# EasyEDA Pro project MyWordEdit.eprj, schematic Schematic1

## Sheets
1 凯华配列: Create Date: 2023-07-25; Page Name: 凯华配列; Project Name: MyWordEdit; Schematic Name: Schematic1; Update Date: 2023-07-29; Company: 嘉立创EDA; Page Size: A4; Version: V1.0
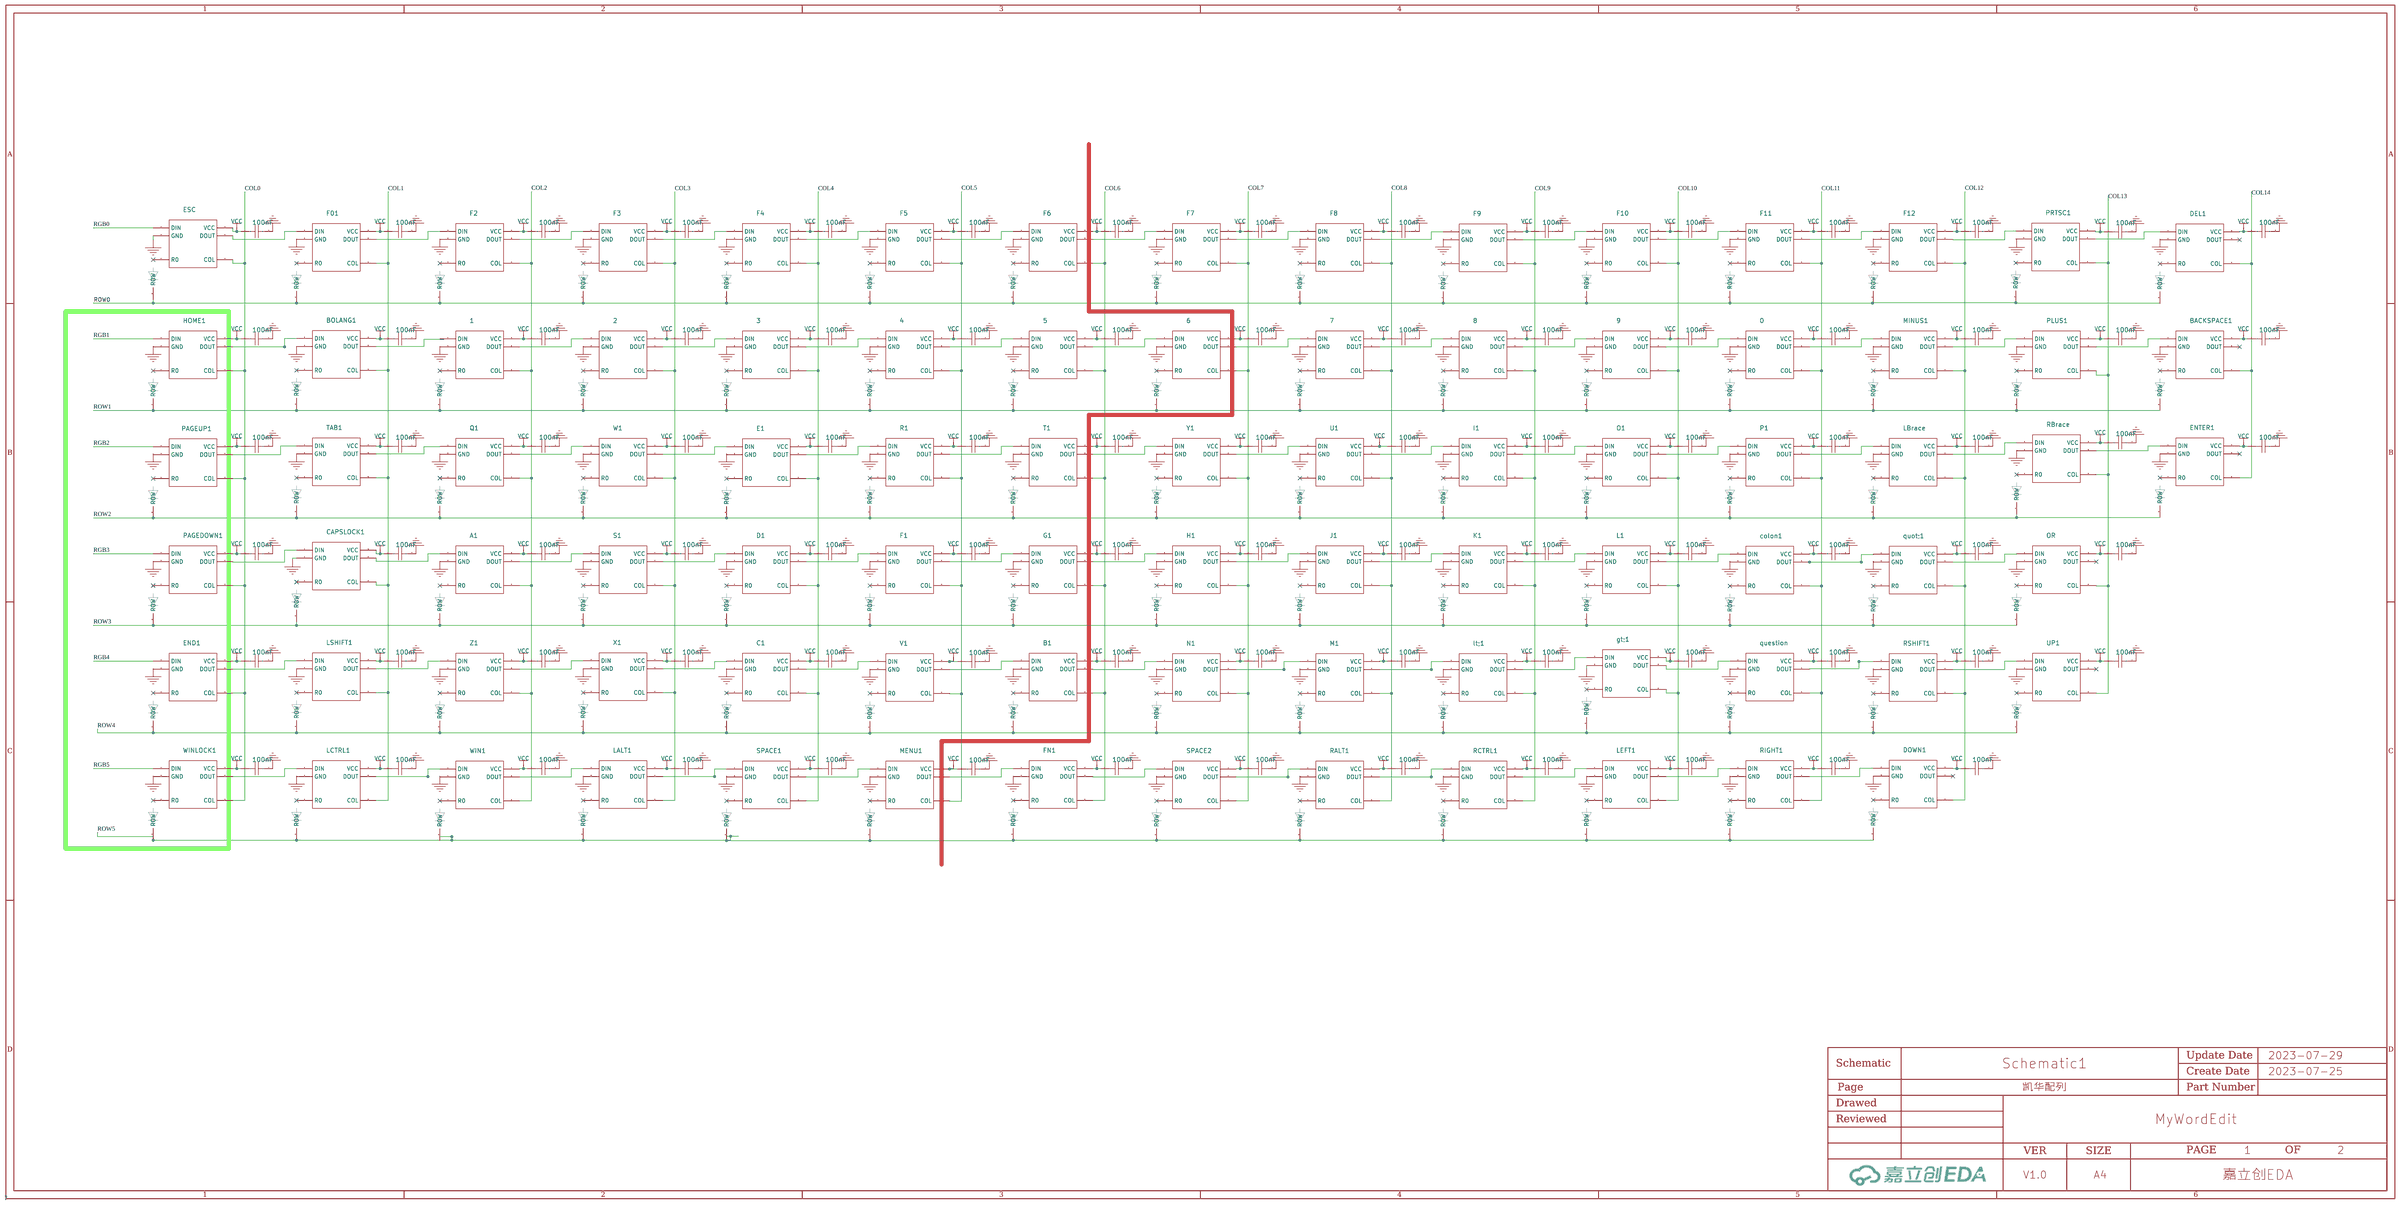
[diagram p0: 凯华配列]
2 主控
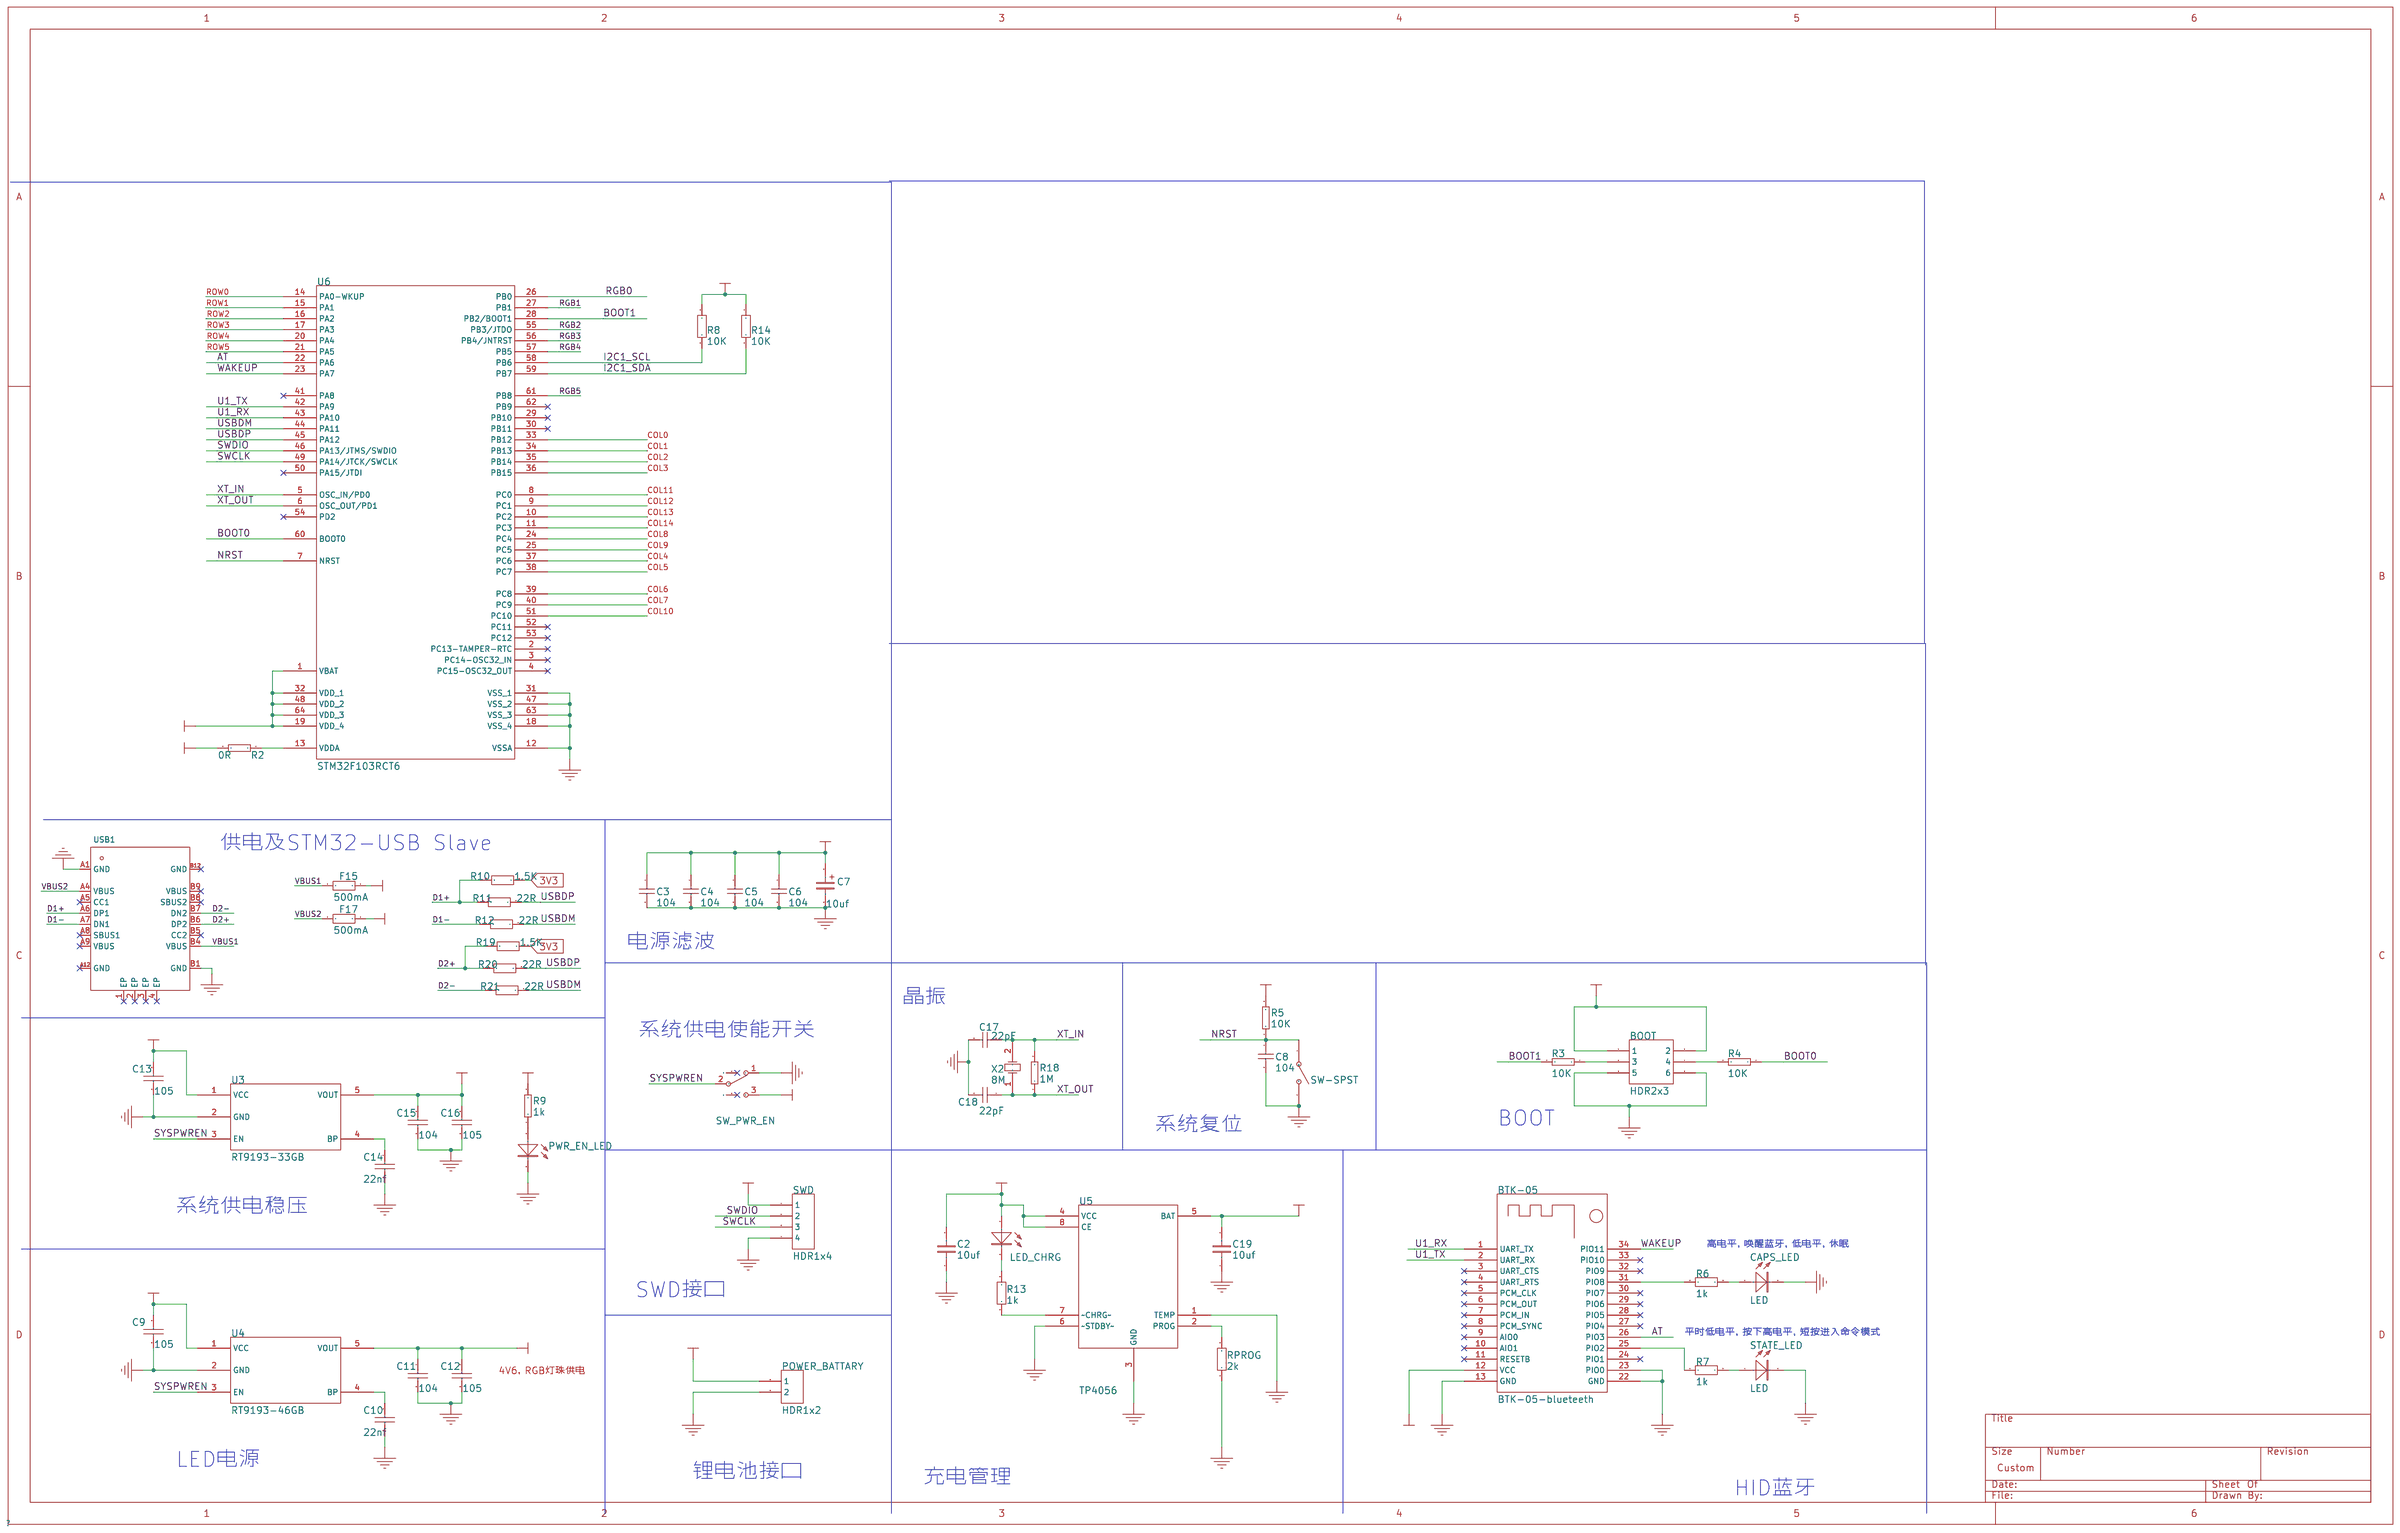
[diagram p1: 主控]

## Parts
sheet 主控
BOOT  HDR2x3  [PIN-2x3-2.54-1.0]
BTK-05  BTK-05-blueteeth  [BTK-05-bluteeth]
C2  10uf  [0805]
C3  100nF  [RC0603]
C4  100nF  [RC0603]
C5  100nF  [RC0603]
C6  100nF  [RC0603]
C7  10uf  [CAP0805]
C8  100nF  [RC0603]
C9  105  [0603]
C10  22nf  [0603]
C11  104  [0603]
C12  105  [0603]
C13  105  [0603]
C14  22nf  [0603]
C15  104  [0603]
C16  105  [0603]
C17  20pF  [RC0603]
C18  20pF  [RC0603]
C19  10uf  [0805]
CAPS_LED  LED  [LED-0805]
F15  500mA  [0805]
F17  500mA  [0805]
LED_CHRG  LED  [LED-0805]
POWER_BATTARY  HDR1x2  [PIN-2-2.54-1.0]
PWR_EN_LED  LED  [LED-0805]
R2  0R  [RC0603]
R3  10K  [RC0603]
R4  10K  [RC0603]
R5  10K  [RC0603]
R6  1k  [0603]
R7  1k  [0603]
R8  10K  [0603]
R9  1k  [0603]
R10  1.5K  [0603]
R11  22R  [0603]
R12  22R  [0603]
R13  1k  [0603]
R14  10K  [0603]
R18  1M  [RC0603]
R19  1.5K  [0603]
R20  22R  [0603]
R21  22R  [0603]
RPROG  2k  [0603]
S2  RESET  [SMT-KEY]
STATE_LED  LED  [LED-0805]
SW_PWR_EN  SWITCH-SPST  [SW-TH_SK-12D02-G040]
SWD  HDR1x4  [PIN-4-2.54-1.0]
U3  RT9193-33GB  [SOT-23-5]
U4  RT9193-46GB  [SOT-23-5]
U5  TP4056  [ESOP8]
U6  STM32F103RCT6  [QFP-64-0.5]
USB1  -  [USB_TYPE-C-16P]
X2  8MHz  [HC49-SMD]
sheet 凯华配列
0  KAILH_WS2182B_3528 反贴  [KAILH_WS2182B_3528 反贴]
1  KAILH_WS2182B_3528 反贴  [KAILH_WS2182B_3528 反贴]
2  KAILH_WS2182B_3528 反贴  [KAILH_WS2182B_3528 反贴]
3  KAILH_WS2182B_3528 反贴  [KAILH_WS2182B_3528 反贴]
4  KAILH_WS2182B_3528 反贴  [KAILH_WS2182B_3528 反贴]
5  KAILH_WS2182B_3528 反贴  [KAILH_WS2182B_3528 反贴]
6  KAILH_WS2182B_3528 反贴  [KAILH_WS2182B_3528 反贴]
7  KAILH_WS2182B_3528 反贴  [KAILH_WS2182B_3528 反贴]
8  KAILH_WS2182B_3528 反贴  [KAILH_WS2182B_3528 反贴]
9  KAILH_WS2182B_3528 反贴  [KAILH_WS2182B_3528 反贴]
A1  KAILH_WS2182B_3528 反贴  [KAILH_WS2182B_3528 反贴]
B1  KAILH_WS2182B_3528 反贴  [KAILH_WS2182B_3528 反贴]
BACKSPACE1  KAILH_WS2182B_3528 反贴  [KAILH_WS2182B_3528 反贴]
BOLANG1  KAILH_WS2182B_3528 反贴  [KAILH_WS2182B_3528 反贴]
C1  KAILH_WS2182B_3528 反贴  [KAILH_WS2182B_3528 反贴]
C_00  100nF  [C0603]
C_01  100nF  [C0603]
C_02  100nF  [C0603]
C_03  100nF  [C0603]
C_04  100nF  [C0603]
C_05  100nF  [C0603]
C_06  100nF  [C0603]
C_07  100nF  [C0603]
C_08  100nF  [C0603]
C_09  100nF  [C0603]
C_A1  100nF  [C0603]
C_B1  100nF  [C0603]
C_BACKSPACE  100nF  [C0603]
C_BOLANG  100nF  [C0603]
C_C1  100nF  [C0603]
C_CAPSLOCK  100nF  [C0603]
C_COLON1  100nF  [C0603]
C_D1  100nF  [C0603]
C_DEL1  100nF  [C0603]
C_DOWN1  100nF  [C0603]
C_E1  100nF  [C0603]
C_END  100nF  [C0603]
C_ENTER1  100nF  [C0603]
C_ESC1  100nF  [C0603]
C_F1  100nF  [C0603]
C_F01  100nF  [C0603]
C_F2  100nF  [C0603]
C_F3  100nF  [C0603]
C_F4  100nF  [C0603]
C_F5  100nF  [C0603]
C_F6  100nF  [C0603]
C_F7  100nF  [C0603]
C_F8  100nF  [C0603]
C_F9  100nF  [C0603]
C_F10  100nF  [C0603]
C_F11  100nF  [C0603]
C_F12  100nF  [C0603]
C_FN1  100nF  [C0603]
C_G1  100nF  [C0603]
C_GT;1  100nF  [C0603]
C_H1  100nF  [C0603]
C_HOME  100nF  [C0603]
C_I1  100nF  [C0603]
C_J1  100nF  [C0603]
C_K1  100nF  [C0603]
C_L1  100nF  [C0603]
C_LALT1  100nF  [C0603]
C_LBRACE  100nF  [C0603]
C_LCTRL  100nF  [C0603]
C_LEFT1  100nF  [C0603]
C_LSHIFT  100nF  [C0603]
C_LT;1  100nF  [C0603]
C_M1  100nF  [C0603]
C_MENU1  100nF  [C0603]
C_MINUS1  100nF  [C0603]
C_N1  100nF  [C0603]
C_O1  100nF  [C0603]
C_OR  100nF  [C0603]
C_P1  100nF  [C0603]
C_PAGEDOWN  100nF  [C0603]
C_PAGEUP  100nF  [C0603]
C_PLUS1  100nF  [C0603]
C_PRTSC1  100nF  [C0603]
C_Q1  100nF  [C0603]
C_QUESTION  100nF  [C0603]
C_QUOT;1  100nF  [C0603]
C_R1  100nF  [C0603]
C_RALT1  100nF  [C0603]
C_RBRACE  100nF  [C0603]
C_RCTRL1  100nF  [C0603]
C_RIGHT1  100nF  [C0603]
C_RSHIFT1  100nF  [C0603]
C_S1  100nF  [C0603]
C_SPACE1  100nF  [C0603]
C_SPACE2  100nF  [C0603]
C_T1  100nF  [C0603]
C_TAB  100nF  [C0603]
C_U1  100nF  [C0603]
C_UP1  100nF  [C0603]
C_V1  100nF  [C0603]
C_W1  100nF  [C0603]
C_WIN1  100nF  [C0603]
C_WINLOCK  100nF  [C0603]
C_X1  100nF  [C0603]
C_Y1  100nF  [C0603]
C_Z1  100nF  [C0603]
CAPSLOCK1  KAILH_WS2182B_3528 反贴  [KAILH_WS2182B_3528 反贴]
colon1  KAILH_WS2182B_3528 反贴  [KAILH_WS2182B_3528 反贴]
D1  KAILH_WS2182B_3528 反贴  [KAILH_WS2182B_3528 反贴]
DEL1  KAILH_WS2182B_3528 反贴  [KAILH_WS2182B_3528 反贴]
DOWN1  KAILH_WS2182B_3528 反贴  [KAILH_WS2182B_3528 反贴]
E1  KAILH_WS2182B_3528 反贴  [KAILH_WS2182B_3528 反贴]
END1  KAILH_WS2182B_3528 反贴  [KAILH_WS2182B_3528 反贴]
ENTER1  KAILH_WS2182B_3528 反贴  [KAILH_WS2182B_3528 反贴]
ESC  KAILH_WS2182B_3528 反贴  [KAILH_WS2182B_3528 反贴]
F1  KAILH_WS2182B_3528 反贴  [KAILH_WS2182B_3528 反贴]
F01  KAILH_WS2182B_3528 反贴  [KAILH_WS2182B_3528 反贴]
F2  KAILH_WS2182B_3528 反贴  [KAILH_WS2182B_3528 反贴]
F3  KAILH_WS2182B_3528 反贴  [KAILH_WS2182B_3528 反贴]
F4  KAILH_WS2182B_3528 反贴  [KAILH_WS2182B_3528 反贴]
F5  KAILH_WS2182B_3528 反贴  [KAILH_WS2182B_3528 反贴]
F6  KAILH_WS2182B_3528 反贴  [KAILH_WS2182B_3528 反贴]
F7  KAILH_WS2182B_3528 反贴  [KAILH_WS2182B_3528 反贴]
F8  KAILH_WS2182B_3528 反贴  [KAILH_WS2182B_3528 反贴]
F9  KAILH_WS2182B_3528 反贴  [KAILH_WS2182B_3528 反贴]
F10  KAILH_WS2182B_3528 反贴  [KAILH_WS2182B_3528 反贴]
F11  KAILH_WS2182B_3528 反贴  [KAILH_WS2182B_3528 反贴]
F12  KAILH_WS2182B_3528 反贴  [KAILH_WS2182B_3528 反贴]
FN1  KAILH_WS2182B_3528 反贴  [KAILH_WS2182B_3528 反贴]
G1  KAILH_WS2182B_3528 反贴  [KAILH_WS2182B_3528 反贴]
gt;1  KAILH_WS2182B_3528 反贴  [KAILH_WS2182B_3528 反贴]
H1  KAILH_WS2182B_3528 反贴  [KAILH_WS2182B_3528 反贴]
HOME1  KAILH_WS2182B_3528 反贴  [KAILH_WS2182B_3528 反贴]
I1  KAILH_WS2182B_3528 反贴  [KAILH_WS2182B_3528 反贴]
J1  KAILH_WS2182B_3528 反贴  [KAILH_WS2182B_3528 反贴]
K1  KAILH_WS2182B_3528 反贴  [KAILH_WS2182B_3528 反贴]
L1  KAILH_WS2182B_3528 反贴  [KAILH_WS2182B_3528 反贴]
LALT1  KAILH_WS2182B_3528 反贴  [KAILH_WS2182B_3528 反贴]
LBrace  KAILH_WS2182B_3528 反贴  [KAILH_WS2182B_3528 反贴]
LCTRL1  KAILH_WS2182B_3528 反贴  [KAILH_WS2182B_3528 反贴]
LEFT1  KAILH_WS2182B_3528 反贴  [KAILH_WS2182B_3528 反贴]
LSHIFT1  KAILH_WS2182B_3528 反贴  [KAILH_WS2182B_3528 反贴]
lt;1  KAILH_WS2182B_3528 反贴  [KAILH_WS2182B_3528 反贴]
M1  KAILH_WS2182B_3528 反贴  [KAILH_WS2182B_3528 反贴]
MENU1  KAILH_WS2182B_3528 反贴  [KAILH_WS2182B_3528 反贴]
MINUS1  KAILH_WS2182B_3528 反贴  [KAILH_WS2182B_3528 反贴]
N1  KAILH_WS2182B_3528 反贴  [KAILH_WS2182B_3528 反贴]
O1  KAILH_WS2182B_3528 反贴  [KAILH_WS2182B_3528 反贴]
OR  KAILH_WS2182B_3528 反贴  [KAILH_WS2182B_3528 反贴]
P1  KAILH_WS2182B_3528 反贴  [KAILH_WS2182B_3528 反贴]
PAGEDOWN1  KAILH_WS2182B_3528 反贴  [KAILH_WS2182B_3528 反贴]
PAGEUP1  KAILH_WS2182B_3528 反贴  [KAILH_WS2182B_3528 反贴]
PLUS1  KAILH_WS2182B_3528 反贴  [KAILH_WS2182B_3528 反贴]
PRTSC1  KAILH_WS2182B_3528 反贴  [KAILH_WS2182B_3528 反贴]
Q1  KAILH_WS2182B_3528 反贴  [KAILH_WS2182B_3528 反贴]
question  KAILH_WS2182B_3528 反贴  [KAILH_WS2182B_3528 反贴]
quot;1  KAILH_WS2182B_3528 反贴  [KAILH_WS2182B_3528 反贴]
R1  KAILH_WS2182B_3528 反贴  [KAILH_WS2182B_3528 反贴]
RALT1  KAILH_WS2182B_3528 反贴  [KAILH_WS2182B_3528 反贴]
RBrace  KAILH_WS2182B_3528 反贴  [KAILH_WS2182B_3528 反贴]
RCTRL1  KAILH_WS2182B_3528 反贴  [KAILH_WS2182B_3528 反贴]
RIGHT1  KAILH_WS2182B_3528 反贴  [KAILH_WS2182B_3528 反贴]
RSHIFT1  KAILH_WS2182B_3528 反贴  [KAILH_WS2182B_3528 反贴]
S1  KAILH_WS2182B_3528 反贴  [KAILH_WS2182B_3528 反贴]
SPACE1  KAILH_WS2182B_3528 反贴  [KAILH_WS2182B_3528 反贴]
SPACE2  KAILH_WS2182B_3528 反贴  [KAILH_WS2182B_3528 反贴]
T1  KAILH_WS2182B_3528 反贴  [KAILH_WS2182B_3528 反贴]
TAB1  KAILH_WS2182B_3528 反贴  [KAILH_WS2182B_3528 反贴]
U1  KAILH_WS2182B_3528 反贴  [KAILH_WS2182B_3528 反贴]
UP1  KAILH_WS2182B_3528 反贴  [KAILH_WS2182B_3528 反贴]
V1  KAILH_WS2182B_3528 反贴  [KAILH_WS2182B_3528 反贴]
W1  KAILH_WS2182B_3528 反贴  [KAILH_WS2182B_3528 反贴]
WIN1  KAILH_WS2182B_3528 反贴  [KAILH_WS2182B_3528 反贴]
WINLOCK1  KAILH_WS2182B_3528 反贴  [KAILH_WS2182B_3528 反贴]
X1  KAILH_WS2182B_3528 反贴  [KAILH_WS2182B_3528 反贴]
Y1  KAILH_WS2182B_3528 反贴  [KAILH_WS2182B_3528 反贴]
Z1  KAILH_WS2182B_3528 反贴  [KAILH_WS2182B_3528 反贴]

## Library data of the parts
BOOT = HDR2x3: Connector; Origin Footprint 2: PIN-2X3-2.0-0.8; Origin Footprint 3: SOCKET-2x3-2.54-1.0; Library Name: General
BTK-05 = BTK-05-blueteeth: Library Name: MyLib
C2 C19 = 10uf: Capacitor; Origin Footprint 2: 0603; Origin Footprint 3: CAP-1206; Origin Footprint 4: CAP-1210; Origin Footprint 5: CAP-1812; Design Item ID: CAP; Library Name: General
C3-C6 C8 = 104: Capacitor; Tolerate: 50V; Revision: 2012-3-28; TOL: 10%; ERP: 0103020075; PCB_Layout: Top Layer SMC; Publisher: ZL_A0OFFICE; Design Item ID: CAP1; Library Name: CommomDevices
C7 = 10uf: Tantalum Capacitor; Origin Footprint 2: CAP-TANTALUM-B; Origin Footprint 3: CAP-TANTALUM-C; Origin Footprint 4: CAP-TANTALUM-D; Origin Footprint 5: CAP-TANTALUM-E; Design Item ID: CAP-TANTALUM; Library Name: General
C9 C12 C13 C16 = 105: Capacitor; Design Item ID: CAP; Library Name: *
C10 C14 = 22nf: Capacitor; Design Item ID: CAP; Library Name: *
C11 C15 = 104: Capacitor; Design Item ID: CAP; Library Name: *
C17 C18 = 22pF: Capacitor; Tolerate: 50V; Revision: 2012-3-28; TOL: 2%; ERP: 0103020090; PCB_Layout: Top Layer SMC; Publisher: ZL_A0OFFICE; Design Item ID: CAP1; Library Name: CommomDevices
CAPS_LED LED_CHRG PWR_EN_LED STATE_LED = LED: Origin Footprint 2: LED-0603; Origin Footprint 3: LED-1206; Origin Footprint 4: LED-PLCC2-3528; Origin Footprint 5: LED-D5; Library Name: General
F15 F17 = 500mA: Resistor; Design Item ID: Res2; Library Name: Miscellaneous Devices
POWER_BATTARY = HDR1x2: Connector; Origin Footprint 2: PIN-2-2.0-0.8; Origin Footprint 3: PH-2; Origin Footprint 4: XH-2; Origin Footprint 5: 5.08-2; Origin Footprint 6: PH-2-SIDE; Origin Footprint 7: PH-2-SIDE-SMD; Origin Footprint 8: XH-2-SIDE; Library Name: General
R2 = 0R: Design Item ID: R; Library Name: ZIBO V2.0_Main
R3-R5 = 10K: Design Item ID: R; Library Name: ZIBO V2.0_Main
R6 R7 = 1k: Resistor; Origin Footprint 2: RES-0805; Origin Footprint 3: RES-0603; Origin Footprint 4: RES-1206; Origin Footprint 5: RES-1210; Origin Footprint 6: RES-1812; Origin Footprint 7: RES-2512; Origin Footprint 8: RES-0.25W-6.5X2.5-10.16-0.6; Origin Footprint 9: RES-0.5W-10.0X3.5-12.7-1; Origin Footprint 10: RES-1W-12.0X5.0-15.24-1; Origin Footprint 11: RES-2W-16.0X5.5-20.32-1; Origin Footprint 12: RES-3W-17.0X6.5-22.86-1; Origin Footprint 13: RES-5W-22.0X10.0-30.48-1; Design Item ID: RES; Library Name: General
R8 R14 = 10k: Resistor; Design Item ID: Res2; Library Name: Miscellaneous Devices
R9 = 1k: Design Item ID: R; Library Name: ZIBO V2.0_Main
R10 R19 = 1.5K: Resistor; Design Item ID: Res2; Library Name: Miscellaneous Devices
R11 R12 R20 R21 = 22R: Resistor; Design Item ID: Res2; Library Name: Miscellaneous Devices
R13 = 1k: Resistor; Origin Footprint 2: RES-0805; Origin Footprint 4: RES-1206; Origin Footprint 5: RES-1210; Origin Footprint 6: RES-1812; Origin Footprint 7: RES-2512; Origin Footprint 8: RES-0.25W-6.5X2.5-10.16-0.6; Origin Footprint 9: RES-0.5W-10.0X3.5-12.7-1; Origin Footprint 10: RES-1W-12.0X5.0-15.24-1; Origin Footprint 11: RES-2W-16.0X5.5-20.32-1; Origin Footprint 12: RES-3W-17.0X6.5-22.86-1; Origin Footprint 13: RES-5W-22.0X10.0-30.48-1; Design Item ID: RES; Library Name: General
R18 = 1M: Design Item ID: R; Library Name: ZIBO V2.0_Main
RPROG = 2k: Resistor; Origin Footprint 2: RES-0805; Origin Footprint 4: RES-1206; Origin Footprint 5: RES-1210; Origin Footprint 6: RES-1812; Origin Footprint 7: RES-2512; Origin Footprint 8: RES-0.25W-6.5X2.5-10.16-0.6; Origin Footprint 9: RES-0.5W-10.0X3.5-12.7-1; Origin Footprint 10: RES-1W-12.0X5.0-15.24-1; Origin Footprint 11: RES-2W-16.0X5.5-20.32-1; Origin Footprint 12: RES-3W-17.0X6.5-22.86-1; Origin Footprint 13: RES-5W-22.0X10.0-30.48-1; Design Item ID: RES; Library Name: General
S2 = SW-SPST: Single-Pole, Single-Throw Switch; Library Name: Miscellaneous Devices
SW_PWR_EN = SWITCH-SPST: Switch; Library Name: General
SWD = HDR1x4: Connector; Origin Footprint 2: PIN-4-2.0-0.8; Origin Footprint 3: PH-4; Origin Footprint 4: XH-4; Origin Footprint 5: 5.08-4; Origin Footprint 6: PH-4-SIDE; Origin Footprint 7: PH-4-SIDE-SMD; Origin Footprint 8: XH-4-SIDE; Library Name: General
U3 U4 = RT9193: Library Name: MyLib
U5 = TP4056: Library Name: MyLib
U6 = STM32F103RCT6: MCU; Design Item ID: STM32F103RxTx; Library Name: General
USB1 = USB_TYPE-C-16P: Supplier Footprint: SMD
X2 = 8M: Crystal Oscillator; ERP: 0103040021; TOL: ±20ppm; Tolerate: ROSON -20_+70 20pf; PCB_Layout: Top Layer SMC; Publisher: ZL_A0OFFICE; Revision: 2012-3-28; Design Item ID: XTAL_SMD; Library Name: CommomDevices
0-9 A1 B1 BACKSPACE1 BOLANG1 C1 CAPSLOCK1 colon1 D1 DEL1 DOWN1 E1 END1 ENTER1 ESC F1 F01-F12 FN1 G1 gt;1 H1 HOME1 I1 J1 K1 L1 LALT1 LBrace LCTRL1 LEFT1 LSHIFT1 lt;1 M1 MENU1 MINUS1 N1 O1 OR P1 PAGEDOWN1 PAGEUP1 PLUS1 PRTSC1 Q1 question quot;1 R1 RALT1 RBrace RCTRL1 RIGHT1 RSHIFT1 S1 SPACE1 SPACE2 T1 TAB1 U1 UP1 V1 W1 WIN1 WINLOCK1 X1 Y1 Z1 = KAILH_WS2182B_3528 反贴: Supplier: LCSC; Supplier Part: C2099
C_00 C_01 C_02 C_03 C_04 C_05 C_06 C_07 C_08 C_09 C_A1 C_B1 C_BACKSPACE C_BOLANG C_C1 C_CAPSLOCK C_COLON1 C_D1 C_DEL1 C_DOWN1 C_E1 C_END C_ENTER1 C_ESC1 C_F1 C_F01-C_F12 C_FN1 C_G1 C_GT;1 C_H1 C_HOME C_I1 C_J1 C_K1 C_L1 C_LALT1 C_LBRACE C_LCTRL C_LEFT1 C_LSHIFT C_LT;1 C_M1 C_MENU1 C_MINUS1 C_N1 C_O1 C_OR C_P1 C_PAGEDOWN C_PAGEUP C_PLUS1 C_PRTSC1 C_Q1 C_QUESTION C_QUOT;1 C_R1 C_RALT1 C_RBRACE C_RCTRL1 C_RIGHT1 C_RSHIFT1 C_S1 C_SPACE1 C_SPACE2 C_T1 C_TAB C_U1 C_UP1 C_V1 C_W1 C_WIN1 C_WINLOCK C_X1 C_Y1 C_Z1 = 100nF: Supplier: LCSC; Supplier Part: C307348; Manufacturer: Samsung Electro-Mechanics; Manufacturer Part: CL10B104KB8WPNC

## Nets
3V3: BOOT.1 BOOT.2 BTK-05.12(VCC) C3.1 C4.1 C5.1 C6.1 C7.1 C15.1 C16.1 R2.2 R5.2 R8.1 R9.2 R10.1 R14.1 R19.1 SWD.1 U3.5(VOUT) U6.1(VBAT) U6.19(VDD_4) U6.32(VDD_1) U6.48(VDD_2) U6.64(VDD_3)
4V8: C9.1 C13.1 C19.2 POWER_BATTARY.1 SW_PWR_EN.3 U3.1(VCC) U4.1(VCC) U5.5(BAT)
5V: C2.2 F15.1 F17.1 LED_CHRG.1(A) U5.4(VCC) U5.8(CE)
GND: 0.GND 1.GND 2.GND 3.GND 4.GND 5.GND 6.GND 7.GND 8.GND 9.GND A1.GND B1.GND BACKSPACE1.GND BOLANG1.GND BOOT.5 BOOT.6 BTK-05.13(GND) BTK-05.22(GND) BTK-05.23(PIO0) C1.GND C2.1 C3.2 C4.2 C5.2 C6.2 C7.2 C8.2 C9.2 C10.2 C11.2 C12.2 C13.2 C14.2 C15.2 C16.2 C17.2 C18.2 C19.1 C_00.2 C_01.2 C_02.2 C_03.2 C_04.2 C_05.2 C_06.2 C_07.2 C_08.2 C_09.2 C_A1.2 C_B1.2 C_BACKSPACE.2 C_BOLANG.2 C_C1.2 C_CAPSLOCK.2 C_COLON1.2 C_D1.2 C_DEL1.2 C_DOWN1.2 C_E1.2 C_END.2 C_ENTER1.2 C_ESC1.2 C_F1.2 C_F01.2 C_F2.2 C_F3.2 C_F4.2 C_F5.2 C_F6.2 C_F7.2 C_F8.2 C_F9.2 C_F10.2 C_F11.2 C_F12.2 C_FN1.2 C_G1.2 C_GT;1.2 C_H1.2 C_HOME.2 C_I1.2 C_J1.2 C_K1.2 C_L1.2 C_LALT1.2 C_LBRACE.2 C_LCTRL.2 C_LEFT1.2 C_LSHIFT.2 C_LT;1.2 C_M1.2 C_MENU1.2 C_MINUS1.2 C_N1.2 C_O1.2 C_OR.2 C_P1.2 C_PAGEDOWN.2 C_PAGEUP.2 C_PLUS1.2 C_PRTSC1.2 C_Q1.2 C_QUESTION.2 C_QUOT;1.2 C_R1.2 C_RALT1.2 C_RBRACE.2 C_RCTRL1.2 C_RIGHT1.2 C_RSHIFT1.2 C_S1.2 C_SPACE1.2 C_SPACE2.2 C_T1.2 C_TAB.2 C_U1.2 C_UP1.2 C_V1.2 C_W1.2 C_WIN1.2 C_WINLOCK.2 C_X1.2 C_Y1.2 C_Z1.2 CAPS_LED.2(C) CAPSLOCK1.GND colon1.GND D1.GND DEL1.GND DOWN1.GND E1.GND END1.GND ENTER1.GND ESC.GND F1.GND F01.GND F2.GND F3.GND F4.GND F5.GND F6.GND F7.GND F8.GND F9.GND F10.GND F11.GND F12.GND FN1.GND G1.GND gt;1.GND H1.GND HOME1.GND I1.GND J1.GND K1.GND L1.GND LALT1.GND LBrace.GND LCTRL1.GND LEFT1.GND LSHIFT1.GND lt;1.GND M1.GND MENU1.GND MINUS1.GND N1.GND O1.GND OR.GND P1.GND PAGEDOWN1.GND PAGEUP1.GND PLUS1.GND POWER_BATTARY.2 PRTSC1.GND PWR_EN_LED.2(C) Q1.GND question.GND quot;1.GND R1.GND RALT1.GND RBrace.GND RCTRL1.GND RIGHT1.GND RPROG.1 RSHIFT1.GND S1.GND S2.2(NO) SPACE1.GND SPACE2.GND STATE_LED.2(C) SW_PWR_EN.1 SWD.4 T1.GND TAB1.GND U1.GND U3.2(GND) U4.2(GND) U5.1(TEMP) U5.3(GND) U5.6(~STDBY~) U6.12(VSSA) U6.18(VSS_4) U6.31(VSS_1) U6.47(VSS_2) U6.63(VSS_3) UP1.GND USB1.A1(GND) USB1.B1(GND) V1.GND W1.GND WIN1.GND WINLOCK1.GND X1.GND Y1.GND Z1.GND
VBUS1: F15.2 USB1.B4(VBUS)
VBUS2: F17.2 USB1.A4(VBUS)
VCC: 0.VCC 1.VCC 2.VCC 3.VCC 4.VCC 5.VCC 6.VCC 7.VCC 8.VCC 9.VCC A1.VCC B1.VCC BACKSPACE1.VCC BOLANG1.VCC C1.VCC C11.1 C12.1 C_00.1 C_01.1 C_02.1 C_03.1 C_04.1 C_05.1 C_06.1 C_07.1 C_08.1 C_09.1 C_A1.1 C_B1.1 C_BACKSPACE.1 C_BOLANG.1 C_C1.1 C_CAPSLOCK.1 C_COLON1.1 C_D1.1 C_DEL1.1 C_DOWN1.1 C_E1.1 C_END.1 C_ENTER1.1 C_ESC1.1 C_F1.1 C_F01.1 C_F2.1 C_F3.1 C_F4.1 C_F5.1 C_F6.1 C_F7.1 C_F8.1 C_F9.1 C_F10.1 C_F11.1 C_F12.1 C_FN1.1 C_G1.1 C_GT;1.1 C_H1.1 C_HOME.1 C_I1.1 C_J1.1 C_K1.1 C_L1.1 C_LALT1.1 C_LBRACE.1 C_LCTRL.1 C_LEFT1.1 C_LSHIFT.1 C_LT;1.1 C_M1.1 C_MENU1.1 C_MINUS1.1 C_N1.1 C_O1.1 C_OR.1 C_P1.1 C_PAGEDOWN.1 C_PAGEUP.1 C_PLUS1.1 C_PRTSC1.1 C_Q1.1 C_QUESTION.1 C_QUOT;1.1 C_R1.1 C_RALT1.1 C_RBRACE.1 C_RCTRL1.1 C_RIGHT1.1 C_RSHIFT1.1 C_S1.1 C_SPACE1.1 C_SPACE2.1 C_T1.1 C_TAB.1 C_U1.1 C_UP1.1 C_V1.1 C_W1.1 C_WIN1.1 C_WINLOCK.1 C_X1.1 C_Y1.1 C_Z1.1 CAPSLOCK1.VCC colon1.VCC D1.VCC DEL1.VCC DOWN1.VCC E1.VCC END1.VCC ENTER1.VCC ESC.VCC F1.VCC F01.VCC F2.VCC F3.VCC F4.VCC F5.VCC F6.VCC F7.VCC F8.VCC F9.VCC F10.VCC F11.VCC F12.VCC FN1.VCC G1.VCC gt;1.VCC H1.VCC HOME1.VCC I1.VCC J1.VCC K1.VCC L1.VCC LALT1.VCC LBrace.VCC LCTRL1.VCC LEFT1.VCC LSHIFT1.VCC lt;1.VCC M1.VCC MENU1.VCC MINUS1.VCC N1.VCC O1.VCC OR.VCC P1.VCC PAGEDOWN1.VCC PAGEUP1.VCC PLUS1.VCC PRTSC1.VCC Q1.VCC question.VCC quot;1.VCC R1.VCC RALT1.VCC RBrace.VCC RCTRL1.VCC RIGHT1.VCC RSHIFT1.VCC S1.VCC SPACE1.VCC SPACE2.VCC T1.VCC TAB1.VCC U1.VCC U4.5(VOUT) UP1.VCC V1.VCC W1.VCC WIN1.VCC WINLOCK1.VCC X1.VCC Y1.VCC Z1.VCC
AT: BTK-05.26(PIO3) U6.22(PA6)
BOOT0: R4.1 U6.60(BOOT0)
BOOT1: R3.2 U6.28(PB2/BOOT1)
COL0: END1.COL ESC.COL HOME1.COL PAGEDOWN1.COL PAGEUP1.COL U6.33(PB12) WINLOCK1.COL
COL1: BOLANG1.COL CAPSLOCK1.COL F01.COL LCTRL1.COL LSHIFT1.COL TAB1.COL U6.34(PB13)
COL2: 1.COL A1.COL F2.COL Q1.COL U6.35(PB14) WIN1.COL Z1.COL
COL3: 2.COL F3.COL LALT1.COL S1.COL U6.36(PB15) W1.COL X1.COL
COL4: 3.COL C1.COL D1.COL E1.COL F4.COL SPACE1.COL U6.37(PC6)
COL5: 4.COL F1.COL F5.COL MENU1.COL R1.COL U6.38(PC7) V1.COL
COL6: 5.COL B1.COL F6.COL FN1.COL G1.COL T1.COL U6.39(PC8)
COL7: 6.COL F7.COL H1.COL N1.COL SPACE2.COL U6.40(PC9) Y1.COL
COL8: 7.COL F8.COL J1.COL M1.COL RALT1.COL U1.COL U6.24(PC4)
COL9: 8.COL F9.COL I1.COL K1.COL lt;1.COL RCTRL1.COL U6.25(PC5)
COL10: 9.COL F10.COL gt;1.COL L1.COL LEFT1.COL O1.COL U6.51(PC10)
COL11: 0.COL colon1.COL F11.COL P1.COL question.COL RIGHT1.COL U6.8(PC0)
COL12: DOWN1.COL F12.COL LBrace.COL MINUS1.COL quot;1.COL RSHIFT1.COL U6.9(PC1)
COL13: OR.COL PLUS1.COL PRTSC1.COL RBrace.COL U6.10(PC2) UP1.COL
COL14: BACKSPACE1.COL DEL1.COL ENTER1.COL U6.11(PC3)
D1+: R10.2 R11.2 USB1.A6(DP1)
D1-: R12.2 USB1.A7(DN1)
D2+: R19.2 R20.2 USB1.B6(DP2)
D2-: R21.2 USB1.B7(DN2)
I2C1_SCL: R8.2 U6.58(PB6)
I2C1_SDA: R14.2 U6.59(PB7)
NRST: C8.1 R5.1 S2.1(COMMON) U6.7(NRST)
RGB0: ESC.DIN U6.26(PB0)
RGB1: HOME1.DIN U6.27(PB1)
RGB2: PAGEUP1.DIN U6.55(PB3/JTDO)
RGB3: PAGEDOWN1.DIN U6.56(PB4/JNTRST)
RGB4: END1.DIN U6.57(PB5)
RGB5: U6.61(PB8) WINLOCK1.DIN
ROW0: DEL1.ROW ESC.ROW F01.ROW F2.ROW F3.ROW F4.ROW F5.ROW F6.ROW F7.ROW F8.ROW F9.ROW F10.ROW F11.ROW F12.ROW PRTSC1.ROW U6.14(PA0-WKUP)
ROW1: 0.ROW 1.ROW 2.ROW 3.ROW 4.ROW 5.ROW 6.ROW 7.ROW 8.ROW 9.ROW BACKSPACE1.ROW BOLANG1.ROW HOME1.ROW MINUS1.ROW PLUS1.ROW U6.15(PA1)
ROW2: E1.ROW ENTER1.ROW I1.ROW LBrace.ROW O1.ROW P1.ROW PAGEUP1.ROW Q1.ROW R1.ROW RBrace.ROW T1.ROW TAB1.ROW U1.ROW U6.16(PA2) W1.ROW Y1.ROW
ROW3: A1.ROW CAPSLOCK1.ROW colon1.ROW D1.ROW F1.ROW G1.ROW H1.ROW J1.ROW K1.ROW L1.ROW OR.ROW PAGEDOWN1.ROW quot;1.ROW S1.ROW U6.17(PA3)
ROW4: B1.ROW C1.ROW END1.ROW gt;1.ROW LSHIFT1.ROW lt;1.ROW M1.ROW N1.ROW question.ROW RSHIFT1.ROW U6.20(PA4) UP1.ROW V1.ROW X1.ROW Z1.ROW
ROW5: DOWN1.ROW FN1.ROW LALT1.ROW LCTRL1.ROW LEFT1.ROW MENU1.ROW RALT1.ROW RCTRL1.ROW RIGHT1.ROW SPACE1.ROW SPACE2.ROW U6.21(PA5) WIN1.ROW WINLOCK1.ROW
SWCLK: SWD.3 U6.49(PA14/JTCK/SWCLK)
SWDIO: SWD.2 U6.46(PA13/JTMS/SWDIO)
SYSPWREN: SW_PWR_EN.2 U3.3(EN) U4.3(EN)
U1_RX: BTK-05.1(UART_TX) U6.43(PA10)
U1_TX: BTK-05.2(UART_RX) U6.42(PA9)
USBDM: R12.1 R21.1 U6.44(PA11)
USBDP: R11.1 R20.1 U6.45(PA12)
WAKEUP: BTK-05.34(PIO11) U6.23(PA7)
XT_IN: C17.1 R18.2 U6.5(OSC_IN/PD0) X2.2
XT_OUT: C18.1 R18.1 U6.6(OSC_OUT/PD1) X2.1
$2N29006: END1.DOUT LSHIFT1.DIN
$2N29026: colon1.DIN L1.DOUT
$2N29033: K1.DOUT L1.DIN
$2N29040: J1.DOUT K1.DIN
$2N29047: H1.DOUT J1.DIN
$2N29054: G1.DOUT H1.DIN
$2N29061: F1.DOUT G1.DIN
$2N29068: D1.DOUT F1.DIN
$2N29075: D1.DIN S1.DOUT
$2N29082: A1.DOUT S1.DIN
$2N29092: LBrace.DOUT RBrace.DIN
$2N29099: LBrace.DIN P1.DOUT
$2N29109: BACKSPACE1.DIN PLUS1.DOUT
$2N29116: O1.DOUT P1.DIN
$2N29123: I1.DOUT O1.DIN
$2N29130: I1.DIN U1.DOUT
$2N29137: U1.DIN Y1.DOUT
$2N29144: T1.DOUT Y1.DIN
$2N29151: R1.DOUT T1.DIN
$2N29158: E1.DOUT R1.DIN
$2N29165: E1.DIN W1.DOUT
$2N29172: Q1.DOUT W1.DIN
$2N29189: MINUS1.DOUT PLUS1.DIN
$2N29196: 0.DOUT MINUS1.DIN
$2N29203: 0.DIN 9.DOUT
$2N29210: 8.DOUT 9.DIN
$2N29217: 7.DOUT 8.DIN
$2N29224: 6.DOUT 7.DIN
$2N29231: 5.DOUT 6.DIN
$2N29238: 4.DOUT 5.DIN
$2N29245: 3.DOUT 4.DIN
$2N29252: 2.DOUT 3.DIN
$2N29259: 1.DOUT 2.DIN
$2N29284: F11.DOUT F12.DIN
$2N29291: F10.DOUT F11.DIN
$2N29298: F9.DOUT F10.DIN
$2N29305: F8.DOUT F9.DIN
$2N29312: F7.DOUT F8.DIN
$2N29319: F6.DOUT F7.DIN
$2N29326: F5.DOUT F6.DIN
$2N29333: F4.DOUT F5.DIN
$2N29340: F3.DOUT F4.DIN
$2N29347: F2.DOUT F3.DIN
$2N29354: F01.DOUT F2.DIN
$2N36381: F12.DOUT PRTSC1.DIN
$2N36513: 1.DIN BOLANG1.DOUT
$2N38445: X1.DIN Z1.DOUT
$2N38463: C1.DOUT V1.DIN
$2N38472: B1.DIN V1.DOUT
$2N38479: B1.DOUT N1.DIN
$2N38485: M1.DIN N1.DOUT
$2N38500: lt;1.DIN M1.DOUT
$2N38515: gt;1.DIN lt;1.DOUT
$2N40060: RSHIFT1.DOUT UP1.DIN
$2N41293: LEFT1.DOUT RIGHT1.DIN
$2N41300: LCTRL1.DIN WINLOCK1.DOUT
$2N41351: LCTRL1.DOUT WIN1.DIN
$2N41356: LALT1.DIN WIN1.DOUT
$2N41358: LALT1.DOUT SPACE1.DIN
$2N41363: MENU1.DIN SPACE1.DOUT
$2N41367: FN1.DIN MENU1.DOUT
$2N41371: FN1.DOUT SPACE2.DIN
$2N41376: RALT1.DIN SPACE2.DOUT
$2N41381: RALT1.DOUT RCTRL1.DIN
$2N41386: LEFT1.DIN RCTRL1.DOUT
$2N42631: DEL1.DIN PRTSC1.DOUT
$2N42705: BOLANG1.DIN HOME1.DOUT
$2N42720: ENTER1.DIN RBrace.DOUT
$2N42725: PAGEUP1.DOUT TAB1.DIN
$2N42734: Q1.DIN TAB1.DOUT
$2N42746: OR.DIN quot;1.DOUT
$2N42752: LSHIFT1.DOUT Z1.DIN
$2N42761: C1.DIN X1.DOUT
$2N43010: colon1.DOUT quot;1.DIN
$2N43134: question.DOUT RSHIFT1.DIN
$2N43163: DOWN1.DIN RIGHT1.DOUT
$2N69049: ESC.DOUT F01.DIN
$2N69230: CAPSLOCK1.DIN PAGEDOWN1.DOUT
$2N69279: A1.DIN CAPSLOCK1.DOUT
$2N69336: gt;1.DOUT question.DIN
$3N1337: R2.1 U6.13(VDDA)
$3N1341: C10.1 U4.4(BP)
$3N1343: C14.1 U3.4(BP)
$3N1436: R13.1 U5.7(~CHRG~)
$3N1469: RPROG.2 U5.2(PROG)
$3N1530: BOOT.3 R3.1
$3N1533: BTK-05.25(PIO2) R7.1
$3N1536: BTK-05.31(PIO8) R6.1
$3N1539: BOOT.4 R4.2
$3N1540: R7.2 STATE_LED.1(A)
$3N1541: CAPS_LED.1(A) R6.2
$3N1559: LED_CHRG.2(C) R13.2
$3N1581: PWR_EN_LED.1(A) R9.1

Not connected (* = marked no-connect by the designer): 0 R0*; 1 R0*; 2 R0*; 3 R0*; 4 R0*; 5 R0*; 6 R0*; 7 R0*; 8 R0*; 9 R0*; A1 R0*; B1 R0*; BACKSPACE1 DOUT* R0*; BOLANG1 R0*; BTK-05 3(UART_CTS)* 4(UART_RTS)* 5(PCM_CLK)* 6(PCM_OUT)* 7(PCM_IN)* 8(PCM_SYNC)* 9(AIO0)* 10(AIO1)* 11(RESETB)* 24(PIO1)* 27(PIO4)* 28(PIO5)* 29(PIO6)* 30(PIO7)* 32(PIO9)* 33(PIO10)*; C1 R0*; CAPSLOCK1 R0*; colon1 R0*; D1 R0*; DEL1 DOUT* R0*; DOWN1 DOUT* R0*; E1 R0*; END1 R0*; ENTER1 DOUT* R0*; ESC R0*; F1 R0*; F01 R0*; F2 R0*; F3 R0*; F4 R0*; F5 R0*; F6 R0*; F7 R0*; F8 R0*; F9 R0*; F10 R0*; F11 R0*; F12 R0*; FN1 R0*; G1 R0*; gt;1 R0*; H1 R0*; HOME1 R0*; I1 R0*; J1 R0*; K1 R0*; L1 R0*; LALT1 R0*; LBrace R0*; LCTRL1 R0*; LEFT1 R0*; LSHIFT1 R0*; lt;1 R0*; M1 R0*; MENU1 R0*; MINUS1 R0*; N1 R0*; O1 R0*; OR DOUT* R0*; P1 R0*; PAGEDOWN1 R0*; PAGEUP1 R0*; PLUS1 R0*; PRTSC1 R0*; Q1 R0*; question R0*; quot;1 R0*; R1 R0*; RALT1 R0*; RBrace R0*; RCTRL1 R0*; RIGHT1 R0*; RSHIFT1 R0*; S1 R0*; SPACE1 R0*; SPACE2 R0*; SW_PWR_EN 4* 5*; T1 R0*; TAB1 R0*; U1 R0*; U6 2(PC13-TAMPER-RTC)* 3(PC14-OSC32_IN)* 4(PC15-OSC32_OUT)* 29(PB10)* 30(PB11)* 41(PA8)* 50(PA15/JTDI)* 52(PC11)* 53(PC12)* 54(PD2)* 62(PB9)*; UP1 DOUT* R0*; USB1 1(EP)* 2(EP)* 3(EP)* 4(EP)* A5(CC1)* A8(SBUS1)* A9(VBUS)* A12(GND)* B5(CC2)* B8(SBUS2)* B9(VBUS)* B12(GND)*; V1 R0*; W1 R0*; WIN1 R0*; WINLOCK1 R0*; X1 R0*; Y1 R0*; Z1 R0*

## Notes on the sheets
sheet 2
- 供电及STM32-USB Slave
- 电源滤波
- 晶振
- 系统供电使能开关
- 系统复位
- BOOT
- 系统供电稳压
- 高电平，唤醒蓝牙，低电平，休眠
- SWD接口
- 平时低电平，按下高电平，短按进入命令模式
- 4V6，RGB灯珠供电
- 锂电池接口
- LED电源
- 充电管理
- HID蓝牙
